# Altium schematic sheet SysUprTestUUDown.SchDoc (continued)
## Parts (continued)
XS1  ConnectorS4_USB_B  [USB_B]  (value not drawn)

## Nets
+3.3V_A: C77.2 C78.2 L6.2 R66.2 XP1.29 XP1.32
+3.3V_D: C63.2 C66.2 C68.2 C70.2 DA8.3(OUT) L6.1 R43.2 R44.2 R66.1 R87.1 XP1.17 XP1.20
+5V_A: C33.2 C34.2 C71.2 C73.2 C75.2 C76.2 DD1.14(Vcc) DD2.14(Vcc) L4.2 R23.1 R25.1 R27.1 R29.1 R52.2 R58.1 R60.1 R62.1 R64.1 XP1.21 XP1.24
+5V_D: C53.2 C55.2 C57.1 C59.2 C67.2 C69.1 DA5.16(Vcc) DA9.16(Vcc) L2.2 R46.2 XP1.9 XP1.12
+5V_I: C19.1 C20.1 C21.1 C29.2 C30.2 C35.2 C36.2 C42.2 C43.2 C61.2 C64.2 C79.2 C85.2 DA3.J9(VOUT) DA4.A3(BIAS2) DA4.A6(BIAS1) FU14.1 L1.1 L2.1 L4.1 L7.1 R45.1 R46.1 R52.1 R80.1 VD14.KA2
+5V_PCB: FU7.2 XP1.33 XP1.36
+9V: C16.1 C17.1 C18.1 C27.2 C28.2 DA1.A3(BIAS2) DA1.A6(BIAS1) DA2.J9(VOUT) DA3.A3(BIAS2) DA3.A6(BIAS1)
+18V: C13.1 C14.1 C15.1 C25.2 C26.2 C49.2 C50.2 C51.2 C52.2 C91.2 C92.2 C93.2 C94.2 DA1.J9(VOUT) DA6.4(+U) DA7.4(+U) DA10.4(+U) DA11.4(+U)
+48V: C1.1 C2.1 C3.1 C4.1 C5.1 C6.1 C7.1 C8.1 C9.1 C10.1 C11.1 C12.1 DA1.J1(VIN) DA2.J1(VIN) DA3.J1(VIN) DA4.J1(VIN) FU1.1 R3.1 R4.1 R5.1 R8.1 VD2.KA2
+48V_IN: VD1.A XP1.1 XP1.4 XP1.5 XP1.8
-5V_A: C72.1 C74.1 L5.2 R53.2 XP1.25 XP1.28
-5V_D: C56.1 C60.1 L3.2 R47.2 XP1.13 XP1.16
-5V_I: C22.1 C23.1 C24.1 C31.2 C32.2 C37.1 C44.1 C62.1 C65.1 C80.1 C86.1 DA4.A1(GND) L3.1 L5.1 L8.1 R10.2 R18.1 R47.1 R53.1 R81.1 VD3.A
-5V_PCB: FU9.2 XP1.37 XP1.40
GND: C1.2 C2.2 C3.2 C4.2 C5.2 C6.2 C7.2 C8.2 C9.2 C10.2 C11.2 C12.2 C13.2 C14.2 C15.2 C16.2 C17.2 C18.2 C19.2 C20.2 C21.2 C22.2 C23.2 C24.2 C25.1 C26.1 C27.1 C28.1 C29.1 C30.1 C31.1 C32.1 C33.1 C34.1 C35.1 C36.1 C37.2 C42.1 C43.1 C44.2 C53.1 C54.1 C55.1 C56.2 C57.2 C58.1 C59.1 C60.2 C63.1 C66.1 C67.1 C68.1 C69.2 C70.1 C75.1 C76.1 C79.1 C80.2 C85.1 C86.2 C95.1 C96.2 C97.1 C98.2 DA1.A1(GND) DA1.C1(SYNC) DA2.A1(GND) DA2.C1(SYNC) DA3.A1(GND) DA3.A5(SS) DA4.J9(VOUT) DA5.9(GND) DA8.2(GND) DA8.4(GND) DA9.9(GND) DD1.7(GND) DD2.7(GND) FU2.2 FU8.1 FU17.1 R2.2 R7.2 R11.2 R12.1 R14.1 R16.1 R19.1 R20.1 R21.1 R22.1 R24.1 R26.1 R28.1 R30.1 R54.1 R55.1 R56.1 R57.1 R59.1 R61.1 R63.1 R65.1 R67.1 R86.1 VD2.KA1 VD3.K VD4.KA1 VD5.KA1 VD6.KA1 VD7.KA1 VD8.KA1 VD9.KA2 VD10.KA1 VD11.KA1 VD12.KA1 VD13.KA1 VD14.KA1 VD15.KA1 VD16.KA1 XP1.10 XP1.11 XP1.14 XP1.15 XP1.18 XP1.19
GND_IN: FU2.1 XP1.2 XP1.3 XP1.6 XP1.7
GND_PCB: FU8.2 XP1.34 XP1.35 XP1.38 XP1.39
GNDA: C38.2 C39.2 C40.2 C41.2 C45.1 C46.1 C47.1 C48.1 C49.1 C50.1 C51.1 C52.1 C61.1 C62.2 C64.1 C65.2 C71.1 C72.2 C73.1 C74.2 C77.1 C78.1 C81.2 C82.2 C83.2 C84.2 C87.1 C88.1 C89.1 C90.1 C91.1 C92.1 C93.1 C94.1 DA5.1(AGND2) DA5.3(A2) DA5.5(AGND4) DA5.7(A4) DA5.17(AGND3) DA5.19(A3) DA5.21(AGND1) DA5.23(A1) DA6.11(-U) DA7.11(-U) DA9.1(AGND2) DA9.3(A2) DA9.5(AGND4) DA9.7(A4) DA9.17(AGND3) DA9.19(A3) DA9.21(AGND1) DA9.23(A1) DA10.11(-U) DA11.11(-U) R31.1 R32.1 R33.1 R34.1 R67.2 R68.1 R69.1 R70.1 R71.1 XP1.22 XP1.23 XP1.26 XP1.27 XP1.30 XP1.31
DS_MISO: DA5.13(SDO) DA9.13(SDO) XP2.34
DS_MOSI: DA5.12(SDI) DA9.12(SDI) XP2.33
OTG_FS_DM: FU16.2 VD15.KA2 XP2.39
OTG_FS_DP: FU15.2 R87.2 VD16.KA2 XP2.38
OTG_FS_ID: R86.2 XP2.40
RS: DA5.15(~{RS}) DA9.15(~{RS}) R43.1
SHCP_CLK: DA5.14(CLK) DA9.14(CLK) XP2.35
SHDN: DA5.10(~{SHDN}) DA9.10(~{SHDN}) R44.1
STCP_CS1: DA5.11(~{CS}) XP2.36
STCP_CS2: DA9.11(~{CS}) XP2.37
VOLT1_EN: DD1.1(A1) R19.2 XP2.2
VOLT1_PCB: FU3.2 XP2.3
VOLT1_UIM: DD1.2(B1) R24.2 XP2.1
VOLT2_EN: DD1.4(A2) R20.2 XP2.5
VOLT2_PCB: FU4.2 XP2.6
VOLT2_UIM: DD1.5(B2) R26.2 XP2.4
VOLT3_EN: DD1.9(A3) R21.2 XP2.8
VOLT3_PCB: FU5.2 XP2.9
VOLT3_UIM: DD1.10(B3) R28.2 XP2.7
VOLT4_EN: DD1.12(A4) R22.2 XP2.11
VOLT4_PCB: FU6.2 XP2.12
VOLT4_UIM: DD1.13(B4) R30.2 XP2.10
VOLT5_EN: DD2.1(A1) R54.2 XP2.14
VOLT5_PCB: FU10.2 XP2.15
VOLT5_UIM: DD2.2(B1) R59.2 XP2.13
VOLT6_EN: DD2.4(A2) R55.2 XP2.17
VOLT6_PCB: FU11.2 XP2.18
VOLT6_UIM: DD2.5(B2) R61.2 XP2.16
VOLT7_EN: DD2.9(A3) R56.2 XP2.20
VOLT7_PCB: FU12.2 XP2.21
VOLT7_UIM: DD2.10(B3) R63.2 XP2.19
VOLT8_EN: DD2.12(A4) R57.2 XP2.23
VOLT8_PCB: FU13.2 XP2.24
VOLT8_UIM: DD2.13(B4) R65.2 XP2.22
NetC38_1: C38.1 C45.2 DA6.3(+1) R31.2 R35.1
NetC39_1: C39.1 C46.2 DA6.10(+3) R32.2 R36.1
NetC40_1: C40.1 C47.2 DA7.3(+1) R33.2 R37.1
NetC41_1: C41.1 C48.2 DA7.10(+3) R34.2 R38.1
NetC54_2: C54.2 C58.2 DA8.1(IN) L1.2 R45.2
NetC81_1: C81.1 C87.2 DA10.3(+1) R68.2 R72.1
NetC82_1: C82.1 C88.2 DA10.10(+3) R69.2 R73.1
NetC83_1: C83.1 C89.2 DA11.3(+1) R70.2 R74.1
NetC84_1: C84.1 C90.2 DA11.10(+3) R71.2 R75.1
NetC95_2: C95.2 C97.2 FU7.1 L7.2 R80.2 VD8.KA2
NetC96_1: C96.1 C98.1 FU9.1 L8.2 R81.2 VD9.KA1
NetDA1_A2: DA1.A2(ADJ) R13.1
NetDA1_A4: DA1.A4(RUN) R3.2
NetDA1_B1: DA1.B1(RT) R1.2
NetDA2_A2: DA2.A2(ADJ) R12.2
NetDA2_A3: DA2.A3(BIAS2) DA2.A6(BIAS1) DA2.A7(AUX)
NetDA2_A4: DA2.A4(RUN) R4.2
NetDA2_B1: DA2.B1(RT) R11.1
NetDA3_A2: DA3.A2(ADJ) R15.1
NetDA3_A4: DA3.A4(RUN) R5.2
NetDA3_B1: DA3.B1(RT) R6.2
NetDA4_A2: DA4.A2(ADJ) R17.1
NetDA4_A4: DA4.A4(RUN) R8.2
NetDA4_B1: DA4.B1(RT) R9.2
NetDA5_2: DA5.2(B2) R25.2
NetDA5_4: DA5.4(W2) R36.2
NetDA5_6: DA5.6(B4) R29.2
NetDA5_8: DA5.8(W4) R38.2
NetDA5_18: DA5.18(W3) R37.2
NetDA5_20: DA5.20(B3) R27.2
NetDA5_22: DA5.22(W1) R35.2
NetDA5_24: DA5.24(B1) R23.2
NetDA6_1: DA6.1(O1) DA6.5(+2) R48.2
NetDA6_2: DA6.2(-1) R39.2 R48.1
NetDA6_6: DA6.6(-2) DA6.7(O2) FU3.1 VD4.KA2
NetDA6_8: DA6.8(O3) DA6.12(+4) R49.2
NetDA6_9: DA6.9(-3) R40.2 R49.1
NetDA6_13: DA6.13(-4) DA6.14(O4) FU4.1 VD5.KA2
NetDA7_1: DA7.1(O1) DA7.5(+2) R50.2
NetDA7_2: DA7.2(-1) R41.2 R50.1
NetDA7_6: DA7.6(-2) DA7.7(O2) FU5.1 VD6.KA2
NetDA7_8: DA7.8(O3) DA7.12(+4) R51.2
NetDA7_9: DA7.9(-3) R42.2 R51.1
NetDA7_13: DA7.13(-4) DA7.14(O4) FU6.1 VD7.KA2
NetDA9_2: DA9.2(B2) R60.2
NetDA9_4: DA9.4(W2) R73.2
NetDA9_6: DA9.6(B4) R64.2
NetDA9_8: DA9.8(W4) R75.2
NetDA9_18: DA9.18(W3) R74.2
NetDA9_20: DA9.20(B3) R62.2
NetDA9_22: DA9.22(W1) R72.2
NetDA9_24: DA9.24(B1) R58.2
NetDA10_1: DA10.1(O1) DA10.5(+2) R82.2
NetDA10_2: DA10.2(-1) R76.2 R82.1
NetDA10_6: DA10.6(-2) DA10.7(O2) FU10.1 VD10.KA2
NetDA10_8: DA10.8(O3) DA10.12(+4) R83.2
NetDA10_9: DA10.9(-3) R77.2 R83.1
NetDA10_13: DA10.13(-4) DA10.14(O4) FU11.1 VD11.KA2
NetDA11_1: DA11.1(O1) DA11.5(+2) R84.2
NetDA11_2: DA11.2(-1) R78.2 R84.1
NetDA11_6: DA11.6(-2) DA11.7(O2) FU12.1 VD12.KA2
NetDA11_8: DA11.8(O3) DA11.12(+4) R85.2
NetDA11_9: DA11.9(-3) R79.2 R85.1
NetDA11_13: DA11.13(-4) DA11.14(O4) FU13.1 VD13.KA2
NetDD1_3: DD1.3(~{Y1}) R39.1
NetDD1_6: DD1.6(~{Y2}) R40.1
NetDD1_8: DD1.8(~{Y3}) R41.1
NetDD1_11: DD1.11(~{Y4}) R42.1
NetDD2_3: DD2.3(~{Y1}) R76.1
NetDD2_6: DD2.6(~{Y2}) R77.1
NetDD2_8: DD2.8(~{Y3}) R78.1
NetDD2_11: DD2.11(~{Y4}) R79.1
NetFU1_2: FU1.2 VD1.K
NetFU14_2: FU14.2 XS1.1
NetFU15_1: FU15.1 XS1.3
NetFU16_1: FU16.1 XS1.2
NetFU17_2: FU17.2 XS1.4
NetR1_1: R1.1 R2.1
NetR6_1: R6.1 R7.1
NetR9_1: R9.1 R10.1
NetR13_2: R13.2 R14.2
NetR15_2: R15.2 R16.2
NetR17_2: R17.2 R18.2

Not connected (* = marked no-connect by the designer): DA1 A5(SS) A7(AUX); DA2 A5(SS); DA3 A7(AUX) C1(SYNC); DA4 A5(SS) A7(AUX) C1(SYNC); XP2 25 26 27 28 29 30 31 32

## Notes on the sheet
- 3
- 15
- 1
- 2
- 13
- 14
- 6
- 18
- 4
- 5
- 16
- 17
- 7
- 9
- 19
- 21
- 8
- 20
- 12
- 24
- 10
- 11
- 22
- 23
- 30
- 31
- 32
- 25
- "USB"
- 26
- 27
- 28
- 33
- 29
- 34
- Перв. примен.
- Справ. №
- Подп. и дата
- Инв. № дубл.
- Взам. инв. №
- Изм.
- Лист
- № докум.
- Подп.
- Дата
- Лит.
- Масса
- Масштаб
- Пров.
- Разраб.
- Листов
- Инв. № подл.
- Н.контр.
- Утв.
- Копировал:
- Формат А1
- (in symbol 1, part A) DA
- (in symbol 1, part B) DA
- (in symbol 1, part C) DA
- (in symbol 1, part D) DA
- (in symbol 1, part E) DA
- (in symbol 26) DC
- (in symbol 60) Цепь; Конт.
- (in symbol 81, part A) &
- (in symbol 81, part B) &
- (in symbol 81, part C) &
- (in symbol 81, part D) &
- (in symbol 112) STU
- (in symbol 445) Конт.; Цепь; Vbus; D-; D+; GND

## Library data of the parts
C1 C2 C4 C5 C7 C8 C10 C11 = 2664: Manufacturer: ОАО «ВЗРД Монолит»; ManufacturerTU: ФЦТА.673516.016ТУ; PartNumber: К10-84в-8060М-100 В-Н90-4,7 мкФ+80/-20 %-О; Alternative: 2220 4,7 мкФ, 100 В, ±10 %; Name: К10-84в; Group: Конденсаторы; ViewControl: В, 10%; Key: 2664; SolderName: K10-84v-8060M-100V-N90-4.7mkF; SolderTemperature: 175; TemperatureRange: от минус 60 до 85; CardKRR: 67; VoltageLimit: 100; X_SORT_2: 200; X_SORT_3: 2; MilitaryControl: ВП; MountType: ПМ; Modify: 13.03.2019; Package: 0805 (8060M); ComponentLink1Description: К10-84; ComponentLink1URL: \\192.168.0.101\U_Base\PDF\C\K10-84.pdf; HelpURL: \\192.168.0.101\U_Base\PDF\C\K10-84.pdf; DataSheet: #\\192.168.0.101\U_Base\PDF\C\K10-84.pdf#; X_SORT_1: 100
C3 C6 C9 C12 = 2253: Manufacturer: ОАО «ВЗРД Монолит»; ManufacturerTU: ФЦТА.673516.016ТУ; PartNumber: К10-84в-3216М-100 В-Н90-0,22 мкФ+80 %-20 %-О; Alternative: 1206 0,22 мкФ, 100 В, ±10 %; Name: К10-84в; Group: Конденсаторы; ViewControl: В, 10%; Key: 2253; SolderName: K10-84v-3216M-100V-N90-0,22mkF; SolderTemperature: 175; TemperatureRange: от минус 60 до 85; CardKRR: 67; VoltageLimit: 100; X_SORT_2: 200; X_SORT_3: 2; MilitaryControl: ВП; MountType: ПМ; Modify: 13.03.2019; Package: 1206 (3216); ComponentLink1Description: К10-84; ComponentLink1URL: \\192.168.0.101\U_Base\PDF\C\K10-84.pdf; HelpURL: \\192.168.0.101\U_Base\PDF\C\K10-84.pdf; DataSheet: #\\192.168.0.101\U_Base\PDF\C\K10-84.pdf#; X_SORT_1: 100
C13 C14 C16 C17 C19 C20 C22 C23 C25-C32 = 2252: Manufacturer: TDK; Notice: TDK 100мкФ 25В; Name: CKG57NX7R1E107M500JH; Group: Конденсаторы; ViewControl: В, 10%; Key: 2252; SolderTemperature: 175; TemperatureRange: от минус 55 до 125; CardKRR: 67; VoltageLimit: 100; X_SORT_3: 2; MilitaryControl: ОТК; MountType: ПМ; Modify: 13.03.2019; PartNumber: CKG57NX7R1E107M500JH; SolderName: CKG57NX7R1E107M500JH; ComponentLink1URL: \\192.168.0.101\U_Base\PDF\C\CKG.pdf; HelpURL: \\192.168.0.101\U_Base\PDF\C\CKG.pdf; DataSheet: #\\192.168.0.101\U_Base\PDF\C\CKG.pdf#
C15 C18 C21 C24 = 2153: Manufacturer: ОАО «ВЗРД Монолит»; ManufacturerTU: ФЦТА.673516.016ТУ; PartNumber: К10-84в-2012М-25 В-Н90-0,22 мкФ+80 %-20 %-N-A; Alternative: 0805 0,22 мкФ, 25 В, ±10 %; Name: К10-84в; Group: Конденсаторы; ViewControl: В, 10%; Key: 2153; SolderName: K10-84v-2012M-25V-N90-0,22mkF; SolderTemperature: 175; TemperatureRange: от минус 60 до 85; CardKRR: 67; VoltageLimit: 50; X_SORT_1: 100; X_SORT_2: 200; X_SORT_3: 2; MilitaryControl: ВП; MountType: ПМ; Modify: 13.03.2019; Package: 0805 (2012); ComponentLink1Description: К10-84; ComponentLink1URL: \\192.168.0.101\U_Base\PDF\C\K10-84.pdf; HelpURL: \\192.168.0.101\U_Base\PDF\C\K10-84.pdf; DataSheet: #\\192.168.0.101\U_Base\PDF\C\K10-84.pdf#
C33 C38-C44 C49 C51 C57-C60 C64 C65 C69 C70 C73-C75 C78 C81-C86 C91 C93 C97 C98 = 2161: PartNumber: К10-84в-2012М-50 В-Н90-0,1 мкФ+80 %-20 %-N-A; Manufacturer: ОАО «ВЗРД Монолит»; ManufacturerTU: ФЦТА.673516.016ТУ; Alternative: 0805 0,1 мкФ, 50 В, ±10 %; Name: К10-84в; Group: Конденсаторы; ViewControl: В, 10%; SolderName: K10-84v-2012M-50V-N90-0,1mkF; X_SORT_1: 100; X_SORT_2: 200; X_SORT_3: 2; SolderTemperature: 175; TemperatureRange: от минус 60 до 85; CardKRR: 67; VoltageLimit: 50; Key: 2161; MilitaryControl: ВП; MountType: ПМ; Modify: 13.03.2019; Package: 0805 (2012); ComponentLink1Description: К10-84; ComponentLink1URL: \\192.168.0.253\U_Base\PDF\C\K10-84.pdf; HelpURL: \\192.168.0.253\U_Base\PDF\C\K10-84.pdf; DataSheet: #\\192.168.0.253\U_Base\PDF\C\K10-84.pdf#
C34 C50 C52 C76 C92 C94 = 2660: Manufacturer: ОАО «ВЗРД Монолит»; ManufacturerTU: ФЦТА.673516.016ТУ; PartNumber: К10-84в-4532М-25 В-Н90-4,7 мкФ+80 %-20 %-О; Alternative: 1812 4,7 мкФ, 25 В, ±10 %; Name: К10-84в; Group: Конденсаторы; ViewControl: В, 10%; Key: 2660; SolderName: K10-84v-4532M-25V-N90-4.7mkF; SolderTemperature: 175; TemperatureRange: от минус 60 до 85; CardKRR: 67; VoltageLimit: 25; X_SORT_1: 100; X_SORT_2: 200; X_SORT_3: 2; MilitaryControl: ВП; MountType: ПМ; Modify: 13.03.2019; ComponentLink1Description: К10-84; ComponentLink1URL: \\192.168.0.101\U_Base\PDF\C\K10-84.pdf; HelpURL: \\192.168.0.101\U_Base\PDF\C\K10-84.pdf; DataSheet: #\\192.168.0.101\U_Base\PDF\C\K10-84.pdf#
C35-C37 C61 C62 C79 C80 = 2172: PartNumber: К53-56А-16 В-22 мкФ±20 %; Manufacturer: АО «НИИ ГИРИКОНД»; ManufacturerTU: АЖЯР.673546.001ТУ; Alternative: Case C 22 мкФ, 16 В, ±20 %; Alternative2: К53-56А-16 В-22 мкФ±20 % В АДПК.673546.005ТУ; Name: К53-56А; Group: Конденсаторы; ViewControl: В, 10%; SolderName: K53-56A-16V-22mkF; X_SORT_1: 100; X_SORT_2: 200; X_SORT_3: 2; SolderTemperature: 265; TemperatureRange: от минус 60 до 125; CardKRR: 67; VoltageLimit: 16; Key: 2172; MilitaryControl: ВП; MountType: ПМ; Modify: 13.03.2019; Package: K3 (Case С); ComponentLink1Description: К53-56А; ComponentLink1URL: \\192.168.0.253\U_Base\PDF\C\K53-56.pdf; HelpURL: \\192.168.0.253\U_Base\PDF\C\K53-56.pdf; DataSheet: #\\192.168.0.253\U_Base\PDF\C\К53-56А.pdf#
C45-C48 C53 C54 C67 C71 C77 C87-C90 = 2164: PartNumber: К53-56А-16 В-4,7 мкФ±20 %; Manufacturer: АО «НИИ ГИРИКОНД»; ManufacturerTU: АЖЯР.673546.001ТУ; Alternative: Case B 4,7 мкФ, 16 В, ±20 %; Alternative2: К53-56А-16 В-4,7 мкФ±20 % В АДПК.673546.005ТУ; Name: К53-56А; Group: Конденсаторы; ViewControl: В, 10%; SolderName: K53-56A-16V-4.7mkF; X_SORT_1: 100; X_SORT_2: 200; X_SORT_3: 2; SolderTemperature: 265; TemperatureRange: от минус 60 до 125; CardKRR: 67; VoltageLimit: 16; Key: 2164; MilitaryControl: ВП; MountType: ПМ; Modify: 13.03.2019; Package: K2 (Case B); ComponentLink1Description: К53-56А; ComponentLink1URL: \\192.168.0.253\U_Base\PDF\C\K53-56.pdf; HelpURL: \\192.168.0.253\U_Base\PDF\C\K53-56.pdf; DataSheet: #\\192.168.0.253\U_Base\PDF\C\К53-56А.pdf#
C55 C56 C72 C95 C96 = 2164: Manufacturer: АО «НИИ ГИРИКОНД»; ManufacturerTU: АЖЯР.673546.001ТУ; PartNumber: К53-56А-16 В-4,7 мкФ±20 %; Alternative: Case B 4,7 мкФ, 16 В, ±20 %; Alternative2: К53-56А-16 В-4,7 мкФ±20 % В АДПК.673546.005ТУ; Name: К53-56А; Group: Конденсаторы; ViewControl: В, 10%; Key: 2164; SolderName: K53-56A-16V-4.7mkF; SolderTemperature: 265; TemperatureRange: от минус 60 до 125; CardKRR: 67; VoltageLimit: 16; X_SORT_1: 100; X_SORT_2: 200; X_SORT_3: 2; MilitaryControl: ВП; MountType: ПМ; Modify: 13.03.2019; Package: K2 (Case B); ComponentLink1Description: К53-56А; ComponentLink1URL: \\192.168.0.253\U_Base\PDF\C\K53-56.pdf; HelpURL: \\192.168.0.253\U_Base\PDF\C\K53-56.pdf; DataSheet: #\\192.168.0.253\U_Base\PDF\C\К53-56А.pdf#
C63 C66 C68 = 2249: PartNumber: К53-67-10 В-330 мкФ±10 %; Manufacturer: АО «НИИ ГИРИКОНД»; ManufacturerTU: АЖЯР.673546.006ТУ; Alternative: Case D 330 мкФ, 10 В, ±10 %; Name: К53-67; Group: Конденсаторы; ViewControl: В, 10%; SolderName: K53-67-10V-330mkF; X_SORT_1: 100; X_SORT_2: 200; X_SORT_3: 2; SolderTemperature: 265; TemperatureRange: от минус 60 до 125; CardKRR: 67; VoltageLimit: 32; Key: 2249; MilitaryControl: ВП; MountType: ПМ; Modify: 13.03.2019; Package: K3 (Case D); ComponentLink1Description: К53-67
DA1-DA4 = 26: Notice: Analog Devices; Group: Микросхемы; CardKRR: 64; ViewControl: В, 100%; key: 26; TemperatureRange: от минус 55 до 125; X_SORT_1: 200; X_SORT_2: 401; X_SORT_3: 2; Manufacturer: Analog Devices; HelpURL: \\192.168.0.101\U_Base\PDF\D\LTM8027.pdf; Name: LTM8027; MilitaryControl: ОТК; MountType: ПМ; Modify: 14.03.2019; PartNumber: LTM8027MPV#PBF; SolderName: LTM8027MPV; Package: LGA113; ComponentLink1URL: \\192.168.0.101\U_Base\PDF\D\LTM8027.pdf; DataSheet: #\\192.168.0.101\U_Base\PDF\D\LTM8027.pdf#
DA5 DA9 = 1: Manufacturer: ОАО «ИНТЕГРАЛ»; ManufacturerTU: АЕЯР.431320.701-03ТУ; Group: Микросхемы; Alternative: AD8403ARZ10; CardKRR: 65; Name: 1315ПТ24Т; ViewControl: В, 100%; key: 1; SolderName: 1315PT24T; TemperatureRange: от минус 60 до 125; X_SORT_1: 200; X_SORT_2: 400; X_SORT_3: 2; HelpURL: \\192.168.0.101\U_Base\PDF\D\Серия 1315.pdf; MilitaryControl: ВП; MountType: РМ; Modify: 14.03.2019; PartNumber: 1315ПТ24Т; Package: 4118.24-2; ComponentLink1URL: \\192.168.0.101\U_Base\PDF\D\Серия 1315.pdf; DataSheet: #\\192.168.0.101\U_Base\PDF\D\Серия 1315.pdf#; ComponentLink2Description: Аналог AD8403; ComponentLink2URL: \\192.168.0.253\U_Base\PDF\D\AD8403.pdf
DA6 DA7 DA10 DA11 = 24: Notice: Analog Devices; Group: Микросхемы; CardKRR: 63; Name: AD824ARZ-14; ViewControl: В, 100%; key: 24; TemperatureRange: от минус 60 до 150; X_SORT_1: 200; X_SORT_2: 401; X_SORT_3: 2; Manufacturer: Analog Devices; HelpURL: \\192.168.0.101\U_Base\PDF\D\AD824.pdf; MilitaryControl: ОТК; MountType: ПМ; Modify: 14.03.2019; PartNumber: AD824ARZ-14; SolderName: AD824ARZ-14; Package: SOIC14; ComponentLink1URL: \\192.168.0.101\U_Base\PDF\D\AD824.pdf; DataSheet: #\\192.168.0.101\U_Base\PDF\D\AD824.pdf#
DA8 = 112: Manufacturer: Texas Instruments; Group: Микросхемы; CardKRR: 64; Name: LM2937IMP-3.3/NOPB; ViewControl: В, 100%; key: 112; TemperatureRange: от минус 40 до 125; VoltageLimit: 26; X_SORT_1: 200; X_SORT_2: 401; X_SORT_3: 2; MilitaryControl: ОТК; MountType: ПМ; Modify: 12.11.2020; PartNumber: LM2937IMP-3.3/NOPB; SolderName: LM2937IMP-3.3/NOPB
DD1 DD2 = 81: Manufacturer: ОАО «ИНТЕГРАЛ»; ManufacturerTU: бК0.347.364-01ТУ; Group: Микросхемы; CardKRR: 65; CurrentLimit: 0,0038; Name: 1533ЛА3; ViewControl: В, 100%; key: 81; TemperatureRange: от минус 60 до 125; X_SORT_1: 200; X_SORT_2: 400; X_SORT_3: 2; HelpURL: \\192.168.0.101\U_Base\PDF\D\1533ЛА3.pdf; MilitaryControl: ВП; MountType: РМ; Modify: 17.04.2019; PartNumber: 1533ЛА3; SolderName: 1533LA3; Package: 401.14-5; ComponentLink1URL: \\192.168.0.101\U_Base\PDF\D\1533ЛА3.pdf; DataSheet: #\\192.168.0.101\U_Base\PDF\D\1533ЛА3.pdf#
FU1 FU2 FU14 FU17 = 77: Manufacturer: Bourns; PartNumber: Предохранитель самовосстанавливающийся MF-MSMF200, 2 A; Name: MF-MSMF200, 2 A; Group: Предохранитель; ViewControl: В,100%; Key: 77; SolderName: MF-MSMF200,2 A; Mass: 0,1; TemperatureRange: от минус 40 до 85; CardKRR: 87; X_SORT_3: 2; MilitaryControl: ОТК; MountType: РМ; Modify: 05.12.2022; ComponentLink1URL: \\192.168.0.101\U_Base\PDF\OTHER\MF-MSMFxxx.pdf; HelpURL: \\192.168.0.101\U_Base\PDF\OTHER\MF-MSMFxxx.pdf; DataSheet: #\\192.168.0.101\U_Base\PDF\OTHER\MF-MSMFxxx.pdf#
FU3-FU6 FU10-FU13 = 70: Manufacturer: Bourns; PartNumber: Предохранитель самовосстанавливающийся MF-MSMF010, 0.1 A; Name: MF-MSMF010, 0.1 A; Group: Предохранитель; ViewControl: В,100%; Key: 70; SolderName: MF-MSMF010,0.1 A; Mass: 0,1; TemperatureRange: от минус 40 до 85; CardKRR: 87; X_SORT_3: 2; MilitaryControl: ОТК; MountType: РМ; Modify: 05.12.2022; ComponentLink1URL: \\192.168.0.101\U_Base\PDF\OTHER\MF-MSMFxxx.pdf; HelpURL: \\192.168.0.101\U_Base\PDF\OTHER\MF-MSMFxxx.pdf; DataSheet: #\\192.168.0.101\U_Base\PDF\OTHER\MF-MSMFxxx.pdf#
FU7-FU9 FU15 FU16 = 74: Manufacturer: Bourns; PartNumber: Предохранитель самовосстанавливающийся MF-MSMF050, 0.5 A; Name: MF-MSMF050, 0.5 A; Group: Предохранитель; ViewControl: В,100%; Key: 74; SolderName: MF-MSMF050,0.5 A; Mass: 0,1; TemperatureRange: от минус 40 до 85; CardKRR: 87; X_SORT_3: 2; MilitaryControl: ОТК; MountType: РМ; Modify: 05.12.2022; ComponentLink1URL: \\192.168.0.101\U_Base\PDF\OTHER\MF-MSMFxxx.pdf; HelpURL: \\192.168.0.101\U_Base\PDF\OTHER\MF-MSMFxxx.pdf; DataSheet: #\\192.168.0.101\U_Base\PDF\OTHER\MF-MSMFxxx.pdf#
L1-L8 = 4177: PartNumber: BLM31PG601SH1; Notice: Murata; Group: Индуктивности; ViewControl: В, 10%; X_SORT_1: 300; X_SORT_2: 701; X_SORT_3: 2; Mass: 0,025; TemperatureRange: от минус 55 до 125; CardKRR: 86; CurrentLimit: 1,5; Key: 4177; Name: BLM31PG601SH1; Manufacturer: Murata; MilitaryControl: ОТК; MountType: ПМ; Modify: 20.02.2019; SolderName: BLM31PG601SH1; Package: 1206 (3216); ComponentLink1URL: \\192.168.0.253\U_Base\PDF\L\BLM31PG.pdf; HelpURL: \\192.168.0.253\U_Base\PDF\L\BLM31PG.pdf; DataSheet: #\\192.168.0.253\U_Base\PDF\L\BLM31PG.pdf#
R1 = 32904924: Manufacturer: АО «НПО «Эркон»; ManufacturerTU: ОЖ0.467.164ТУ; PartNumber: Р1-8В-0,1-27 кОм±5 %-Т-А; Alternative: 0603 27 кОм, 0,1 Вт, ±5 %; Alternative2: Р1-8В-0,1-27 кОм±5 %-Т-А ОЖ0.467.164ТУ; Name: Р1-8В; Group: Резисторы; ViewControl: В, 10%; SolderName: R1-8B-0.1-27kOm; Mark: 273; Mass: 0,002; SolderTemperature: 255; TemperatureRange: от минус 65 до 155; CardKRR: 68; VoltageLimit: 100; PowerLimit: 0,1; X_SORT_1: 400; X_SORT_3: 2; Modify: 07.09.2022; MilitaryControl: ВП; MountType: ПМ; key: 32904924; Package: 0603 (1608); ComponentLink1Description: Р1-8В; ComponentLink1URL: \\192.168.0.101\U_Base\PDF\R\Р1-8В.pdf; HelpURL: \\192.168.0.101\U_Base\PDF\R\Р1-8В.pdf; DataSheet: #\\192.168.0.101\U_Base\PDF\R\Р1-8В.pdf#; X_SORT_2: 100
R2 = 2991: Manufacturer: АО «НПО «Эркон»; ManufacturerTU: ОЖ0.467.164ТУ; PartNumber: Р1-8В-0,125-4,7 кОм±5 %-Т-А; Alternative: 0805 4,7 кОм, 0,125 Вт, ±5 %; Alternative2: Р1-8В-0,125-4,7 кОм±5 %-Т-А ОЖ0.467.164ТУ; Name: Р1-8В; Group: Резисторы; ViewControl: В, 10%; key: 2991; SolderName: R1-8B-0.125-4.7kOm; Mark: 472; Mass: 0,006; SolderTemperature: 255; TemperatureRange: от минус 65 до 155; CardKRR: 68; VoltageLimit: 150; PowerLimit: 0,125; X_SORT_1: 400; X_SORT_2: 100; X_SORT_3: 2; Modify: 28.06.2019; MilitaryControl: ВП; MountType: ПМ; Package: 0805 (2012); ComponentLink1Description: Р1-8В; ComponentLink1URL: \\192.168.0.101\U_Base\PDF\R\Р1-8В.pdf; HelpURL: \\192.168.0.101\U_Base\PDF\R\Р1-8В.pdf; DataSheet: #\\192.168.0.101\U_Base\PDF\R\Р1-8В.pdf#
R3-R5 R8 = 32904808: Manufacturer: АО «НПО «Эркон»; ManufacturerTU: ОЖ0.467.164ТУ; PartNumber: Р1-8В-0,125-1 МОм±5 %-Т-А; Alternative2: Р1-8В-0,125-1 МОм±5 %-Т-А ОЖ0.467.164ТУ; Name: Р1-8В; Group: Резисторы; ViewControl: В, 10%; SolderName: R1-8B-0.125-1MOm; SolderTemperature: 255; TemperatureRange: от минус 65 до 155; CardKRR: 68; VoltageLimit: 150; PowerLimit: 0,125; X_SORT_1: 400; X_SORT_2: 100; X_SORT_3: 2; Modify: 28.06.2019; MilitaryControl: ВП; MountType: ПМ; key: 32904808; ComponentLink1Description: Р1-8В; ComponentLink1URL: \\192.168.0.101\U_Base\PDF\R\Р1-8В.pdf; HelpURL: \\192.168.0.101\U_Base\PDF\R\Р1-8В.pdf; DataSheet: #\\192.168.0.101\U_Base\PDF\R\Р1-8В.pdf#
R6 = 3005: Manufacturer: АО «НПО «Эркон»; ManufacturerTU: ОЖ0.467.164ТУ; PartNumber: Р1-8В-0,125-68 кОм±5 %-Т-А; Alternative: 0805 68 кОм, 0,125 Вт, ±5 %; Alternative2: Р1-8В-0,125-68 кОм±5 %-Т-А ОЖ0.467.164ТУ; Name: Р1-8В; Group: Резисторы; ViewControl: В, 10%; key: 3005; SolderName: R1-8B-0.125-68kOm; Mark: 683; Mass: 0,006; SolderTemperature: 255; TemperatureRange: от минус 65 до 155; CardKRR: 68; VoltageLimit: 150; PowerLimit: 0,125; X_SORT_1: 400; X_SORT_2: 100; X_SORT_3: 2; Modify: 28.06.2019; MilitaryControl: ВП; MountType: ПМ; Package: 0805 (2012); ComponentLink1Description: Р1-8В; ComponentLink1URL: \\192.168.0.101\U_Base\PDF\R\Р1-8В.pdf; HelpURL: \\192.168.0.101\U_Base\PDF\R\Р1-8В.pdf; DataSheet: #\\192.168.0.101\U_Base\PDF\R\Р1-8В.pdf#
R7 = 3003: Manufacturer: АО «НПО «Эркон»; ManufacturerTU: ОЖ0.467.164ТУ; PartNumber: Р1-8В-0,125-6,8 кОм±5 %-Т-А; Alternative: 0805 6,8 кОм, 0,125 Вт, ±5 %; Alternative2: Р1-8В-0,125-6,8 кОм±5 %-Т-А ОЖ0.467.164ТУ; Name: Р1-8В; Group: Резисторы; ViewControl: В, 10%; key: 3003; SolderName: R1-8B-0.125-6.8kOm; Mark: 682; Mass: 0,006; SolderTemperature: 255; TemperatureRange: от минус 65 до 155; CardKRR: 68; VoltageLimit: 150; PowerLimit: 0,125; X_SORT_1: 400; X_SORT_2: 100; X_SORT_3: 2; Modify: 28.06.2019; MilitaryControl: ВП; MountType: ПМ; Package: 0805 (2012); ComponentLink1Description: Р1-8В; ComponentLink1URL: \\192.168.0.101\U_Base\PDF\R\Р1-8В.pdf; HelpURL: \\192.168.0.101\U_Base\PDF\R\Р1-8В.pdf; DataSheet: #\\192.168.0.101\U_Base\PDF\R\Р1-8В.pdf#
R9 = 32904921: Manufacturer: АО «НПО «Эркон»; ManufacturerTU: ОЖ0.467.164ТУ; PartNumber: Р1-8В-0,125-82 кОм±5 %-Т-А; Alternative: 0805, 82кОм, 0,125 Вт, ±5 %; Alternative2: Р1-8В-0,125-82 кОм±5 %-Т-А ОЖ0.467.164ТУ; Name: Р1-8В; Group: Резисторы; ViewControl: В, 10%; SolderName: R1-8B-0.125-82kOm; Mark: 823; Mass: 0,006; SolderTemperature: 255; TemperatureRange: от минус 65 до 155; CardKRR: 68; VoltageLimit: 150; PowerLimit: 0,125; X_SORT_1: 400; X_SORT_2: 100; X_SORT_3: 2; Modify: 28.06.2019; MilitaryControl: ВП; MountType: ПМ; key: 32904921; Package: 0805 (2012); ComponentLink1Description: Р1-8В; ComponentLink1URL: \\192.168.0.101\U_Base\PDF\R\Р1-8В.pdf; HelpURL: \\192.168.0.101\U_Base\PDF\R\Р1-8В.pdf; DataSheet: #\\192.168.0.101\U_Base\PDF\R\Р1-8В.pdf#
R10 = 2963: Manufacturer: АО «НПО «Эркон»; ManufacturerTU: ОЖ0.467.164ТУ; PartNumber: Р1-8В-0,125-10 кОм±5 %-Т-А; Alternative: 0805 10 кОм, 0,125 Вт, ±5 %; Alternative2: Р1-8В-0,125-10 кОм±5 %-Т-А ОЖ0.467.164ТУ; Name: Р1-8В; Group: Резисторы; ViewControl: В, 10%; key: 2963; SolderName: R1-8B-0.125-10kOm; Mark: 103; Mass: 0,006; SolderTemperature: 255; TemperatureRange: от минус 65 до 155; CardKRR: 68; VoltageLimit: 150; PowerLimit: 0,125; X_SORT_1: 400; X_SORT_2: 100; X_SORT_3: 2; Modify: 28.06.2019; MilitaryControl: ВП; MountType: ПМ; Package: 0805 (2012); ComponentLink1Description: Р1-8В; ComponentLink1URL: \\192.168.0.101\U_Base\PDF\R\Р1-8В.pdf; HelpURL: \\192.168.0.101\U_Base\PDF\R\Р1-8В.pdf; DataSheet: #\\192.168.0.101\U_Base\PDF\R\Р1-8В.pdf#
R11 R13 = 2986: Manufacturer: АО «НПО «Эркон»; ManufacturerTU: ОЖ0.467.164ТУ; PartNumber: Р1-8В-0,125-33 кОм±5 %-Т-А; Alternative: 0805 33 кОм, 0,125 Вт, ±5 %; Alternative2: Р1-8В-0,125-33 кОм±5 %-Т-А ОЖ0.467.164ТУ; Name: Р1-8В; Group: Резисторы; ViewControl: В, 10%; key: 2986; SolderName: R1-8B-0.125-33kOm; Mark: 333; Mass: 0,006; SolderTemperature: 255; TemperatureRange: от минус 65 до 155; CardKRR: 68; VoltageLimit: 150; PowerLimit: 0,125; X_SORT_1: 400; X_SORT_2: 100; X_SORT_3: 2; Modify: 28.06.2019; MilitaryControl: ВП; MountType: ПМ; Package: 0805 (2012); ComponentLink1Description: Р1-8В; ComponentLink1URL: \\192.168.0.101\U_Base\PDF\R\Р1-8В.pdf; HelpURL: \\192.168.0.101\U_Base\PDF\R\Р1-8В.pdf; DataSheet: #\\192.168.0.101\U_Base\PDF\R\Р1-8В.pdf#
R12 = 32904922: Manufacturer: АО «НПО «Эркон»; ManufacturerTU: ОЖ0.467.164ТУ; PartNumber: Р1-8В-0,125-75 кОм±5 %-Т-А; Alternative: 0805 75 кОм, 0,125 Вт, ±5 %; Alternative2: Р1-8В-0,125-75 кОм±5 %-Т-А ОЖ0.467.164ТУ; Name: Р1-8В; Group: Резисторы; ViewControl: В, 10%; SolderName: R1-8B-0.125-75kOm; Mark: 753; Mass: 0,006; SolderTemperature: 255; TemperatureRange: от минус 65 до 155; CardKRR: 68; VoltageLimit: 150; PowerLimit: 0,125; X_SORT_1: 400; X_SORT_2: 100; X_SORT_3: 2; Modify: 28.06.2019; MilitaryControl: ВП; MountType: ПМ; key: 32904922; Package: 0805 (2012); ComponentLink1Description: Р1-8В; ComponentLink1URL: \\192.168.0.101\U_Base\PDF\R\Р1-8В.pdf; HelpURL: \\192.168.0.101\U_Base\PDF\R\Р1-8В.pdf; DataSheet: #\\192.168.0.101\U_Base\PDF\R\Р1-8В.pdf#
R14 = 32904932: Manufacturer: АО «НПО «Эркон»; ManufacturerTU: ОЖ0.467.164ТУ; PartNumber: Р1-8В-0,125-3,6 кОм±5 %-Т-А; Alternative: 0805 3,6 кОм, 0,125 Вт, ±5 %; Alternative2: Р1-8В-0,125-3,6 кОм±5 %-Т-А ОЖ0.467.164ТУ; Name: Р1-8В; Group: Резисторы; ViewControl: В, 10%; SolderName: R1-8B-0.125-3.6kOm; Mark: 362; Mass: 0,006; SolderTemperature: 255; TemperatureRange: от минус 65 до 155; CardKRR: 68; VoltageLimit: 150; PowerLimit: 0,125; X_SORT_1: 400; X_SORT_2: 100; X_SORT_3: 2; Modify: 07.10.2022; MilitaryControl: ВП; MountType: ПМ; key: 32904932; Package: 0805 (2012); ComponentLink1Description: Р1-8В; ComponentLink1URL: \\192.168.0.101\U_Base\PDF\R\Р1-8В.pdf; HelpURL: \\192.168.0.101\U_Base\PDF\R\Р1-8В.pdf; DataSheet: #\\192.168.0.101\U_Base\PDF\R\Р1-8В.pdf#
R15 R17 = 2970: Manufacturer: АО «НПО «Эркон»; ManufacturerTU: ОЖ0.467.164ТУ; PartNumber: Р1-8В-0,125-150 кОм±5 %-Т-А; Alternative: 0805 150 кОм, 0,125 Вт, ±5 %; Alternative2: Р1-8В-0,125-150 кОм±5 %-Т-А ОЖ0.467.164ТУ; Name: Р1-8В; Group: Резисторы; ViewControl: В, 10%; key: 2970; SolderName: R1-8B-0.125-150kOm; Mark: 154; Mass: 0,006; SolderTemperature: 255; TemperatureRange: от минус 65 до 155; CardKRR: 68; VoltageLimit: 150; PowerLimit: 0,125; X_SORT_1: 400; X_SORT_2: 100; X_SORT_3: 2; Modify: 28.06.2019; MilitaryControl: ВП; MountType: ПМ; Package: 0805 (2012); ComponentLink1Description: Р1-8В; ComponentLink1URL: \\192.168.0.101\U_Base\PDF\R\Р1-8В.pdf; HelpURL: \\192.168.0.101\U_Base\PDF\R\Р1-8В.pdf; DataSheet: #\\192.168.0.101\U_Base\PDF\R\Р1-8В.pdf#
R16 R18 = 32904920: Manufacturer: АО «НПО «Эркон»; ManufacturerTU: ОЖ0.467.164ТУ; PartNumber: Р1-8В-0,125-12 кОм±5 %-Т-А; Alternative: 0805 12 кОм, 0,125 Вт, ±5 %; Alternative2: Р1-8В-0,125-12 кОм±5 %-Т-А ОЖ0.467.164ТУ; Name: Р1-8В; Group: Резисторы; ViewControl: В, 10%; SolderName: R1-8B-0.125-12kOm; Mark: 123; Mass: 0,006; SolderTemperature: 255; TemperatureRange: от минус 65 до 155; CardKRR: 68; VoltageLimit: 150; PowerLimit: 0,125; X_SORT_1: 400; X_SORT_2: 100; X_SORT_3: 2; Modify: 28.06.2019; MilitaryControl: ВП; MountType: ПМ; key: 32904920; Package: 0805 (2012); ComponentLink1Description: Р1-8В; ComponentLink1URL: \\192.168.0.101\U_Base\PDF\R\Р1-8В.pdf; HelpURL: \\192.168.0.101\U_Base\PDF\R\Р1-8В.pdf; DataSheet: #\\192.168.0.101\U_Base\PDF\R\Р1-8В.pdf#
R19-R22 R24 R26 R28 R30 R43 R44 R54-R57 R59 R61 R63 R65 = 2905: Manufacturer: АО «НПО «Эркон»; ManufacturerTU: ОЖ0.467.164ТУ; PartNumber: Р1-8В-0,063-10 кОм±5 %-Т-А; Alternative: 0402 10 кОм, 0,062 Вт, ±5 %; Alternative2: Р1-8В-0,062-10 кОм±5 %-Т-А ОЖ0.467.164ТУ; Name: Р1-8В; Group: Резисторы; ViewControl: В, 10%; key: 2905; SolderName: R1-8B-0.063-10kOm; Mark: 103; Mass: 0,0007; SolderTemperature: 255; TemperatureRange: от минус 65 до 155; CardKRR: 68; VoltageLimit: 50; PowerLimit: 0,063; X_SORT_1: 400; X_SORT_2: 100; X_SORT_3: 2; Modify: 28.06.2019; MilitaryControl: ВП; MountType: ПМ; Package: 0402 (1005); ComponentLink1Description: Р1-8В; ComponentLink1URL: \\192.168.0.101\U_Base\PDF\R\Р1-8В.pdf; HelpURL: \\192.168.0.101\U_Base\PDF\R\Р1-8В.pdf; DataSheet: #\\192.168.0.101\U_Base\PDF\R\Р1-8В.pdf#
R23 R25 R27 R29 R58 R60 R62 R64 = 32904931: Manufacturer: АО «НПО «Эркон»; ManufacturerTU: ОЖ0.467.164ТУ; PartNumber: Р1-8В-0,125-5,6 кОм±5 %-Т-А; Alternative: 0805 5,6 кОм, 0,125 Вт, ±5 %; Alternative2: Р1-8В-0,125-5,6 кОм±5 %-Т-А ОЖ0.467.164ТУ; Name: Р1-8В; Group: Резисторы; ViewControl: В, 10%; SolderName: R1-8B-0.125-5.6kOm; Mark: 562; Mass: 0,006; SolderTemperature: 255; TemperatureRange: от минус 65 до 155; CardKRR: 68; VoltageLimit: 150; PowerLimit: 0,125; X_SORT_1: 400; X_SORT_2: 100; X_SORT_3: 2; Modify: 28.06.2019; MilitaryControl: ВП; MountType: ПМ; key: 32904931; Package: 0805 (2012); ComponentLink1Description: Р1-8В; ComponentLink1URL: \\192.168.0.101\U_Base\PDF\R\Р1-8В.pdf; HelpURL: \\192.168.0.101\U_Base\PDF\R\Р1-8В.pdf; DataSheet: #\\192.168.0.101\U_Base\PDF\R\Р1-8В.pdf#
R31-R38 R68-R75 = 32904929: Manufacturer: АО «НПО «Эркон»; ManufacturerTU: ОЖ0.467.164ТУ; PartNumber: Р1-8В-0,125-2 кОм±5 %-Т-А; Alternative: 0805 2 кОм, 0,125 Вт, ±5 %; Alternative2: Р1-8В-0,125-2 кОм±5 %-Т-А ОЖ0.467.164ТУ; Name: Р1-8В; Group: Резисторы; ViewControl: В, 10%; SolderName: R1-8B-0.125-2kOm; Mark: 202; Mass: 0,006; SolderTemperature: 255; TemperatureRange: от минус 65 до 155; CardKRR: 68; VoltageLimit: 150; PowerLimit: 0,125; X_SORT_1: 400; X_SORT_2: 100; X_SORT_3: 2; Modify: 28.06.2019; MilitaryControl: ВП; MountType: ПМ; key: 32904929; Package: 0805 (2012); ComponentLink1Description: Р1-8В; ComponentLink1URL: \\192.168.0.101\U_Base\PDF\R\Р1-8В.pdf; HelpURL: \\192.168.0.101\U_Base\PDF\R\Р1-8В.pdf; DataSheet: #\\192.168.0.101\U_Base\PDF\R\Р1-8В.pdf#
R39-R42 R76-R79 = 2901: Manufacturer: АО «НПО «Эркон»; ManufacturerTU: ОЖ0.467.164ТУ; PartNumber: Р1-8В-0,063-1 кОм±5 %-Т-А; Alternative: 0402 1 кОм, 0,062 Вт, ±5 %; Alternative2: Р1-8В-0,062-1 кОм±5 %-Т-А ОЖ0.467.164ТУ; Name: Р1-8В; Group: Резисторы; ViewControl: В, 10%; key: 2901; SolderName: R1-8B-0.063-1kOm; Mark: 102; Mass: 0,0007; SolderTemperature: 255; TemperatureRange: от минус 65 до 155; CardKRR: 68; VoltageLimit: 50; PowerLimit: 0,063; X_SORT_1: 400; X_SORT_2: 100; X_SORT_3: 2; Modify: 28.06.2019; MilitaryControl: ВП; MountType: ПМ; Package: 0402 (1005); ComponentLink1Description: Р1-8В; ComponentLink1URL: \\192.168.0.101\U_Base\PDF\R\Р1-8В.pdf; HelpURL: \\192.168.0.101\U_Base\PDF\R\Р1-8В.pdf; DataSheet: #\\192.168.0.101\U_Base\PDF\R\Р1-8В.pdf#
R45-R47 R52 R53 R66 R80 R81 = 3037: PartNumber: Р1-8В-0,25-100 Ом±5 %-Т-А; Manufacturer: АО «НПО «Эркон»; ManufacturerTU: ОЖ0.467.164ТУ; Alternative: 1206 100 Ом, 0,25 Вт, ±5 %; Alternative2: Р1-8В-0,25-100 Ом±5 %-Т-А ОЖ0.467.164ТУ; Name: Р1-8В; Group: Резисторы; ViewControl: В, 10%; SolderName: R1-8B-0.25-100Om; Mark: 101; X_SORT_1: 400; X_SORT_3: 2; Mass: 0,01; SolderTemperature: 255; TemperatureRange: от минус 65 до 155; CardKRR: 68; VoltageLimit: 200; PowerLimit: 0,25; key: 3037; Modify: 28.06.2019; MilitaryControl: ВП; MountType: ПМ; X_SORT_2: 100; Package: 1206 (3216); ComponentLink1Description: Р1-8В; ComponentLink1URL: \\192.168.0.253\U_Base\PDF\R\Р1-8В.pdf; HelpURL: \\192.168.0.253\U_Base\PDF\R\Р1-8В.pdf; DataSheet: \\192.168.0.253\U_Base\PDF\R\Р1-8В.pdf
R48-R51 R82-R85 = 32904937: Manufacturer: АО «НПО «Эркон»; ManufacturerTU: ОЖ0.467.164ТУ; PartNumber: Р1-8В-0,125-20 кОм±5 %-Т-А; Alternative: 0805 20 кОм, 0,125 Вт, ±5 %; Alternative2: Р1-8В-0,125-20 кОм±5 %-Т-А ОЖ0.467.164ТУ; Name: Р1-8В; Group: Резисторы; ViewControl: В, 10%; SolderName: R1-8B-0.125-20kOm; Mark: 203; Mass: 0,006; SolderTemperature: 255; TemperatureRange: от минус 65 до 155; CardKRR: 68; VoltageLimit: 150; PowerLimit: 0,125; X_SORT_1: 400; X_SORT_2: 100; X_SORT_3: 2; Modify: 17.01.2023; MilitaryControl: ВП; MountType: ПМ; key: 32904937; Package: 0805 (2012); ComponentLink1Description: Р1-8В; ComponentLink1URL: \\192.168.0.101\U_Base\PDF\R\Р1-8В.pdf; HelpURL: \\192.168.0.101\U_Base\PDF\R\Р1-8В.pdf; DataSheet: #\\192.168.0.101\U_Base\PDF\R\Р1-8В.pdf#
R67 = 3121: PartNumber: Р1-8В-1,0-0,15 Ом±20 %-А; Manufacturer: АО «НПО «Эркон»; ManufacturerTU: ОЖ0.467.164ТУ; Alternative: 2512 0,15 Ом, 1 Вт, ±5 %; Alternative2: Р1-8В-1,0-0,15 Ом±20 %-А ОЖ0.467.164ТУ; Name: Р1-8В; Group: Резисторы; ViewControl: В, 10%; SolderName: R1-8B-1.0-0.15Om; Mark: 0R15; X_SORT_1: 400; X_SORT_2: 100; X_SORT_3: 2; Mass: 0,04; SolderTemperature: 255; TemperatureRange: от минус 65 до 155; CardKRR: 68; VoltageLimit: 200; PowerLimit: 1; key: 3121; Modify: 28.06.2019; MilitaryControl: ВП; MountType: ПМ; Package: 2512 (6432); ComponentLink1Description: Р1-8В; ComponentLink1URL: \\192.168.0.253\U_Base\PDF\R\Р1-8В.pdf; HelpURL: \\192.168.0.253\U_Base\PDF\R\Р1-8В.pdf; DataSheet: \\192.168.0.253\U_Base\PDF\R\Р1-8В.pdf
R86 = 2965: Manufacturer: АО «НПО «Эркон»; ManufacturerTU: ОЖ0.467.164ТУ; PartNumber: Р1-8В-0,125-100 кОм±5 %-Т-А; Alternative: 0805 100 кОм, 0,125 Вт, ±5 %; Alternative2: Р1-8В-0,125-100 кОм±5 %-Т-А ОЖ0.467.164ТУ; Name: Р1-8В; Group: Резисторы; ViewControl: В, 10%; key: 2965; SolderName: R1-8B-0.125-100kOm; Mark: 104; Mass: 0,006; SolderTemperature: 255; TemperatureRange: от минус 65 до 155; CardKRR: 68; VoltageLimit: 150; PowerLimit: 0,125; X_SORT_1: 400; X_SORT_2: 100; X_SORT_3: 2; Modify: 28.06.2019; MilitaryControl: ВП; MountType: ПМ; Package: 0805 (2012); ComponentLink1Description: Р1-8В; ComponentLink1URL: \\192.168.0.101\U_Base\PDF\R\Р1-8В.pdf; HelpURL: \\192.168.0.101\U_Base\PDF\R\Р1-8В.pdf; DataSheet: #\\192.168.0.101\U_Base\PDF\R\Р1-8В.pdf#
R87 = 2960: Manufacturer: АО «НПО «Эркон»; ManufacturerTU: ОЖ0.467.164ТУ; PartNumber: Р1-8В-0,125-1,5 кОм±5 %-Т-А; Alternative: 0805 1,5 кОм, 0,125 Вт, ±5 %; Alternative2: Р1-8В-0,125-1,5 кОм±5 %-Т-А ОЖ0.467.164ТУ; Name: Р1-8В; Group: Резисторы; ViewControl: В, 10%; key: 2960; SolderName: R1-8B-0.125-1.5kOm; Mark: 152; Mass: 0,006; SolderTemperature: 255; TemperatureRange: от минус 65 до 155; CardKRR: 68; VoltageLimit: 150; PowerLimit: 0,125; X_SORT_1: 400; X_SORT_2: 100; X_SORT_3: 2; Modify: 28.06.2019; MilitaryControl: ВП; MountType: ПМ; Package: 0805 (2012); ComponentLink1Description: Р1-8В; ComponentLink1URL: \\192.168.0.101\U_Base\PDF\R\Р1-8В.pdf; HelpURL: \\192.168.0.101\U_Base\PDF\R\Р1-8В.pdf; DataSheet: #\\192.168.0.101\U_Base\PDF\R\Р1-8В.pdf#
VD1 = 93: Manufacturer: MIC; Notice: DC Components; Group: Диоды; ViewControl: В, 10%; key: 93; SolderTemperature: 260; TemperatureRange: от минус 65 до 150; CardKRR: 55; X_SORT_1: 500; X_SORT_2: 300; X_SORT_3: 2; Modify: 14.03.2019; MilitaryControl: ОТК; MountType: РМ; PartNumber: HER307; SolderName: HER307; Package: DO-201; ComponentLink1Description: HER307; ComponentLink1URL: \\192.168.0.101\U_Base\PDF\V\HER307.pdf; HelpURL: \\192.168.0.101\U_Base\PDF\V\HER307.pdf; DataSheet: #\\192.168.0.101\U_Base\PDF\V\HER307.pdf#
VD2 = 167: Manufacturer: STMicroelectronics; Group: Диоды; key: 167; TemperatureRange: от минус 55 до 150; CardKRR: 55; X_SORT_3: 2; Modify: 20.01.2023; PartNumber: SMBJ58CA; SolderName: SMBJ58CA; ComponentLink1URL: \\192.168.0.101\U_Base\PDF\V\Bourns_SMBJ.pdf; HelpURL: \\192.168.0.101\U_Base\PDF\V\Bourns_SMBJ.pdf; DataSheet: #\\192.168.0.101\U_Base\PDF\V\Bourns_SMBJ.pdf#
VD3 = 23: Manufacturer: АО «НИИПП»; ManufacturerTU: АЕЯР.432120.206ТУ; PartNumber: Диод Шоттки 3Д713А; Alternative: SR160; Group: Диоды; ViewControl: В, 10%; key: 23; SolderName: 3D713A; Mass: 0,001; TemperatureRange: от минус 65 до 125; CardKRR: 55; X_SORT_1: 500; X_SORT_2: 300; X_SORT_3: 2; Modify: 14.03.2019; MilitaryControl: ВП; MountType: РМ; Package: KD-4; ComponentLink1Description: 3Д713; ComponentLink1URL: \\192.168.0.101\U_Base\PDF\V\РД 11 0909.3-2005.pdf; HelpURL: \\192.168.0.101\U_Base\PDF\V\РД 11 0909.3-2005.pdf; DataSheet: #\\192.168.0.101\U_Base\PDF\V\РД 11 0909.3-2005.pdf#
VD4-VD7 VD10-VD13 = 166: Manufacturer: STMicroelectronics; Group: Диоды; key: 166; TemperatureRange: от минус 55 до 150; CardKRR: 55; X_SORT_3: 2; Modify: 20.01.2023; PartNumber: SMBJ18CA; SolderName: SMBJ18CA; ComponentLink1URL: \\192.168.0.101\U_Base\PDF\V\Bourns_SMBJ.pdf; HelpURL: \\192.168.0.101\U_Base\PDF\V\Bourns_SMBJ.pdf; DataSheet: #\\192.168.0.101\U_Base\PDF\V\Bourns_SMBJ.pdf#
VD8 VD9 VD14-VD16 = 163: Manufacturer: STMicroelectronics; PartNumber: Диод защитный SMBJ5.0CA-TR; Alternative: SMBJ5.0CA-TR YJ; Value: SMBJ5.0CA; Group: Диоды; ViewControl: В, 10%; key: 163; Mass: 0.26; SolderTemperature: 260; TemperatureRange: от минус 55 до 150; CardKRR: 56; VoltageLimit: 13,4; X_SORT_3: 2; Modify: 05.12.2022; MilitaryControl: ОТК; MountType: ПМ; SolderName: SMBJ5.0CA; ComponentLink1URL: \\192.168.0.101\U_Base\PDF\V\SMBJ.pdf; HelpURL: \\192.168.0.101\U_Base\PDF\V\SMBJ.pdf; DataSheet: #\\192.168.0.101\U_Base\PDF\V\SMBJ.pdf#
XP1 = 60: Manufacturer: АО «Карачевский завод Электродеталь»; ManufacturerTU: РЮМК.430420.011ТУ; PartNumber: Вилка СНП346-40ВП22-2-В; Conn01Name: +48V_IN; Conn02Name: GND_IN; Conn09Name: +5V_D; Conn10Name: GND; Conn13Name: -5V_D; Conn17Name: +3.3V_D; Conn22Name: GNDA; Conn25Name: -5V_A; Conn29Name: +3.3V_A; Conn33Name: +5V_PCB; Conn34Name: GND_PCB; Conn37Name: -5V_PCB; Alternative2: СНП346-40ВП22-2 РЮМК.430420.019ТУ; Name: СНП346-40ВП22-2-В; Value: 40; Group: Соединители; ViewControl: В, 10%; key: 60; SolderName: SNP346-40VP22-2; Mass: 0,0024; TemperatureRange: от минус 60 до 85; CardKRR: 75; VoltageLimit: 250; CurrentLimit: 1; X_SORT_1: 700; X_SORT_2: 600; X_SORT_3: 2; Conn03Name: GND_IN; Conn04Name: +48V_IN; Conn05Name: +48V_IN; Conn06Name: GND_IN; Conn07Name: GND_IN; Conn08Name: +48V_IN; Conn11Name: GND; Conn12Name: +5V_D; Conn14Name: GND; Conn15Name: GND; Conn16Name: -5V_D; Conn18Name: GND; Conn19Name: GND; Conn20Name: +3.3V_D; Conn21Name: -5V_D; Conn23Name: GNDA; Conn24Name: -5V_D; Conn26Name: GNDA; Conn27Name: GNDA; Conn28Name: -5V_A; Conn30Name: GNDA; Conn31Name: GNDA; Conn32Name: +3.3V_A; Conn35Name: GND_PCB; Conn36Name: +5V_PCB; Conn38Name: GND_PCB; Conn39Name: GND_PCB; Conn40Name: -5V_PCB; Alternative: PLD-40; MilitaryControl: ВП; MountType: РМ; Modify: 19.09.2018; Package: PLD; ComponentLink1Description: СНП346; ComponentLink1URL: \\192.168.0.101\U_Base\PDF\X\СНП346.pdf; HelpURL: \\192.168.0.101\U_Base\PDF\X\СНП346.pdf; DataSheet: #\\192.168.0.101\U_Base\PDF\X\СНП346.pdf#; PowerLimit: 250
XP2 = 60: Manufacturer: АО «Карачевский завод Электродеталь»; ManufacturerTU: РЮМК.430420.011ТУ; PartNumber: Вилка СНП346-40ВП22-2-В; Conn01Name: VOLT1_UIM; Conn02Name: VOLT1_EN; Conn03Name: VOLT1_PCB; Conn04Name: VOLT2_UIM; Conn05Name: VOLT2_EN; Conn06Name: VOLT2_PCB; Conn07Name: VOLT3_UIM; Conn08Name: VOLT3_EN; Conn09Name: VOLT3_PCB; Conn10Name: VOLT4_UIM; Conn11Name: VOLT4_EN; Conn12Name: VOLT4_PCB; Conn13Name: VOLT5_UIM; Conn14Name: VOLT5_EN; Conn15Name: VOLT5_PCB; Conn16Name: VOLT6_UIM; Conn17Name: VOLT6_EN; Conn18Name: VOLT6_PCB; Conn19Name: VOLT7_UIM; Conn20Name: VOLT7_EN; Conn21Name: VOLT7_PCB; Conn22Name: VOLT8_UIM; Conn23Name: VOLT8_EN; Conn24Name: VOLT8_PCB; Conn25Name: Not_Used; Conn33Name: DS_MOSI; Conn34Name: DS_MISO; Conn35Name: SHCP_CLK; Conn36Name: STCP_CS1; Conn37Name: STCP_CS2; Conn38Name: OTG_FS_DP; Conn39Name: OTG_FS_DM; Conn40Name: OTG_FS_ID; Alternative2: СНП346-40ВП22-2 РЮМК.430420.019ТУ; Name: СНП346-40ВП22-2-В; Value: 40; Group: Соединители; ViewControl: В, 10%; key: 60; SolderName: SNP346-40VP22-2; Mass: 0,0024; TemperatureRange: от минус 60 до 85; CardKRR: 75; VoltageLimit: 250; CurrentLimit: 1; X_SORT_1: 700; X_SORT_2: 600; X_SORT_3: 2; Conn26Name: Not_Used; Conn27Name: Not_Used; Conn28Name: Not_Used; Conn29Name: Not_Used; Conn30Name: Not_Used; Conn31Name: Not_Used; Conn32Name: Not_Used; Alternative: PLD-40; MilitaryControl: ВП; MountType: РМ; Modify: 19.09.2018; Package: PLD; ComponentLink1Description: СНП346; ComponentLink1URL: \\192.168.0.101\U_Base\PDF\X\СНП346.pdf; HelpURL: \\192.168.0.101\U_Base\PDF\X\СНП346.pdf; DataSheet: #\\192.168.0.101\U_Base\PDF\X\СНП346.pdf#; PowerLimit: 250
XS1 = 445: Manufacturer: KLS Electronic Co. Ltd; PartNumber: Розетка L-KLS1-151-W; Conn05Name: 5; Conn06Name: 6; Conn07Name: 7; Conn08Name: 8; Conn09Name: 9; Conn10Name: 10; Conn11Name: 11; Conn12Name: 12; Conn13Name: 13; Conn14Name: 14; Conn15Name: 15; Conn16Name: 16; Conn17Name: 17; Conn18Name: 18; Conn19Name: 19; Conn20Name: 20; Conn21Name: 21; Conn22Name: 22; Conn23Name: 23; Conn24Name: 24; Conn25Name: 25; Conn26Name: 26; Conn27Name: 27; Conn28Name: 28; Conn29Name: 29; Conn30Name: 30; Conn31Name: 31; Conn32Name: 32; Conn33Name: 33; Conn34Name: 34; Conn35Name: 35; Conn36Name: 36; Conn37Name: 37; Conn38Name: 38; Conn39Name: 39; Conn40Name: 40; Conn02Name: 2; Conn03Name: 3; Conn04Name: 4; Conn01Name: 1; Name: L-KLS1-151-W; Group: Соединители; ViewControl: В,100%; key: 445; TemperatureRange: от минус 35 до 85; CardKRR: 75; MilitaryControl: отк; MountType: РМ; Modify: 01.09.2022; Package: L-KLS1; ComponentLink1Description: L-KLS1; ComponentLink1URL: \\192.168.0.101\U_Base\PDF\X\L-KLS1-151-W.pdf; HelpURL: \\192.168.0.101\U_Base\PDF\X\L-KLS1-151-W.pdf; DataSheet: #\\192.168.0.101\U_Base\PDF\X\L-KLS1-151-W.pdf#; X_SORT_3: 2